# EAGLE board MSP-EXP430FR4133_EagleCAD (EAGLE 7.6.0) (continued)
## Tracks (layer width: path | path; a pad name or v marks a point on that pad's centre or on a via) (continued)
EZFET_UARTRXD  (via drill 0.3)
  Top 0.203: MSP101.38 26.31,93.09 26.31,92.84 26.44,92.71 v26.44,92.2 | J101.7 43.97,76.2 42.7,77.47 41.81,77.47 41.17,78.11 v41.17,80.95
  Bottom 0.203: v26.44,92.2 30.63,88.01 33.81,88.01 35.2,86.61 35.2,82.55 37.11,80.65 40.87,80.65 v41.17,80.95
EZFET_UARTTXD  (via drill 0.3)
  Top 0.203: MSP101.37 26.25,93.79 v26.95,93.09 | J101.9 39.95,78.18 39.95,81.33 v39.65,81.64
  Bottom 0.203: v26.95,93.09 27.08,92.08 30.76,88.39 33.93,88.39 35.59,86.74 35.59,82.68 37.24,81.03 39.04,81.03 v39.65,81.64
EZFET_V18
  Top 0.203: MSP101.55 24.45,86.96 23.22,85.73 22,85.73 18.99,82.72 C102.1
EZFET_VBUS  (via drill 0.3)
  Top 0.203: 9.3,91.19 9.3,91.06 IC102.6 | 9.55,91.19 IC102.6 | IC102.6 | 51.1,95.66 51.1,95.93 C109.+
  Top 0.254: IC103.2 50.32,81.41
  Top 0.305: MSP101.53 23.11,87.02 19.86,87.02 17.55,84.71 13.36,84.71 11.71,83.06 11.33,83.06 | 19.33,89.79 IC101.1 IC101.6
  Top 0.406: 50.32,81.41 C126.1 49.3,81.41
  Top 0.508: 9.3,93.09 9.3,91.19 | 9.55,91.19 v10.69,91.69 | J101.17 30.51,77.47 27.84,77.47 27.2,76.84 10.82,76.84 9.8,77.85 9.8,82.3 10.38,82.87 R124.1 11.33,83.06 5.99,88.37 5.99,91.95 7.14,93.09 9.3,93.09 | v18.31,91.69 18.69,92.08 18.69,92.33 19.08,92.71 19.04,92.71 C108.1 19.37,92.67 19.96,92.08 19.96,90.42 19.33,89.79 | J102.1 9.39,93.19 9.3,93.09 | 51.1,95.66 51.1,94.01 51.06,93.96 R120.1 C118.1 51.06,91.65 C117.1 51.59,91.06 51.59,90.42 51.61,90.42 v51.64,90.45 | T101.2 49.32,88.38 | 49.32,88.38 49.3,88.39 | v49.33,88.34 49.33,88.37 49.32,88.38 | v49.05,82.93 49.3,82.68 49.3,81.45 C126.1
  Top 0.635: C109.+ 50.62,95.88 50.39,95.86 v49.48,95.86
  Bottom 0.305: 48.87,95.81 48.74,95.86
  Bottom 0.508: v10.69,91.69 v18.31,91.69 20.47,93.85 20.47,97.79 22.38,99.7 44.86,99.7 48.74,95.86 v49.48,95.86 | v51.64,90.45 50.62,90.45 49.33,89.15 v49.33,88.34 49.33,87.02 48.03,85.73 48.03,83.95 v49.05,82.93
EZFET_VCC  (via drill 0.3)
  Top 0.152: MSP101.11 32.03,87.38 32.07,87.34 | 33.86,86.79 C114.1 | 33.43,88.77 MSP101.15
  Top 0.203: 24.66,93.32 MSP101.40 | v32,81.59 31.58,81.21 R109.2 | R116.1 27.08,99.44 | C114.1 34.06,87.12 | 33.86,86.79 34.13,87.06 | 34.95,94.74 34.98,94.77
  Top 0.254: 17.93,89.53 IC101.3 | IC103.4 51.59,80.39
  Top 0.305: MSP101.40 25.19,92.82 24.28,93.73 C103.1 23.05,94.32 21.49,95.89 21.49,96.01 C104.+ | 25.52,99.34 R117.1 25.44,99.31 | 46.17,99.73 C124.1 46.04,99.2 45.99,99.1 | 48.14,97.71 C106.+ | 43.59,98.81 45.69,98.81 45.99,99.1 | 38.42,96.82 38.38,97.03 38.38,97.54 39.14,98.3 41.3,98.3 43.46,96.14 46.76,96.14 47.56,96.93 C106.+ | 38.42,96.82 38.43,96.75 | 33.6,88.61 MSP101.15 | 32.07,87.34 32.66,86.74 v32.92,86.74 33.76,86.74 34.13,87.06 35.08,88.01 | v37.11,96.7 37.64,96.7 MSP102.16 MSP102.15 38.42,96.82 | C106.+ 47.73,97.38 47.9,97.59 v47.9,98.81 | 46.06,99.05 45.99,99.1 | 35.08,88.01 35.38,87.83 36.55,87.83 38,89.28 38,90.17 35.46,92.71 35.46,94.23 34.98,94.72 34.98,94.77 v34.98,95.45 | 35.08,88.01 35.14,88.01 C113.1 | 35.08,88.01 34.19,88.01 33.43,88.77
  Top 0.406: 17.85,89.88 17.93,89.75 17.93,89.53 | 17.42,92.46 17.3,92.46 C105.1 17.3,92.62 16.88,92.62
  Top 0.508: 16.88,92.62 16.03,93.47 16.03,95.63 16.28,95.89 18.91,95.89 R114.1 21.26,95.84 C104.+ 23.42,96.04 24.03,96.65 24.03,98.68 24.66,99.31 25.44,99.31 27,99.31 R116.1 27.26,99.37 27.97,100.08 42.32,100.08 43.59,98.81 45.62,98.81 46.02,99.14 46.02,99.64 | 17.85,89.88 17.42,90.3 17.42,92.46 17.34,92.67 17.35,92.67 | v47.9,98.81 47.02,99.7 C124.1 | v55.14,79.6 55.14,79.63 54.89,79.38 52.1,79.38 51.59,79.88 51.59,80.39
  Bottom 0.203: v32.92,86.74 32.92,82.5 v32,81.59
  Bottom 0.305: v37.11,96.7 36.22,96.7 v34.98,95.45
  Bottom 0.508: v47.9,98.81 49.68,98.81 55.14,93.34 v55.14,79.6
EZFET_VCCEN1  (via drill 0.3)
  Top 0.203: MSP101.26 30.69,93.15 31.14,93.6 32.03,93.6 32.66,94.23 33.55,94.23 34.57,93.22 34.57,92.46 36.35,90.68 v36.35,89.53 | v50.06,80.39 50.32,80.39 50.83,80.91 IC103.3 | R107.1 43.15,83.88 v43.21,84.2
  Bottom 0.203: v36.35,89.53 36.47,89.41 39.9,89.41 40.54,88.77 40.54,85.09 41.3,84.33 43.08,84.33 v43.21,84.2 45.11,82.3 47.78,82.3 49.68,80.39 v50.06,80.39
EZFET_VCCEN2  (via drill 0.3)
  Top 0.203: MSP101.27 30.29,93.51 30.76,93.98 31.78,93.98 32.41,94.62 33.81,94.62 34.95,93.47 34.95,92.58 37.11,90.42 v37.11,90.04 | R108.1 v44.35,84.2 | IC103.7 52.47,81.91 52.73,82.17 v52.73,82.68
  Bottom 0.203: v37.11,90.04 39.9,90.04 41.05,88.9 41.05,85.34 41.55,84.84 43.71,84.84 v44.35,84.2 45.87,82.68 48.03,82.68 48.54,82.17 49.3,82.17 50.06,82.93 52.48,82.93 v52.73,82.68
EZFET_VCCOUT
  Top 0.203: R121.1 35.93,81.37 37.24,82.68 40.69,82.68 41.81,83.81 | 41.81,83.81 41.81,83.82 41.94,83.82 42.95,84.84 44.22,84.84 44.73,85.34 44.73,85.38 R127.1 | 41.81,83.81 R112.1
  Top 0.254: 51.59,82.42 IC103.8
  Top 0.305: R126.1 44.74,88.01 R128.1 R127.1 45.4,84.96 45.4,83.45 C120.1 | 46.63,83.48 46.63,83.45
  Top 0.508: 50.55,83.92 50.55,83.46 51.59,82.42
  Top 0.635: 46.63,83.48 47.19,83.92 50.43,83.92 C119.1 50.46,83.9 50.47,83.9 | L101.2 50.44,85.82 50.44,84.18 50.42,84.18 50.42,84.07 50.55,84.07 50.55,83.92 50.47,83.92 50.47,83.9 | 50.47,83.87 50.47,83.9 | 46.63,83.45 C120.1
EZFET_VCCTARGET  (via drill 0.3)
  Top 0.254: IC103.5 52.21,80.91
  Top 0.305: IC103.1 50.71,81.91 v50.32,82.3 | 52.21,80.91 52.6,80.91 52.73,80.77 v52.73,80.21
  Bottom 0.508: J101.15 36.09,77.98 50.5,77.98 v52.73,80.21 52.73,81.15 51.59,82.3 v50.32,82.3
EZFET_VCORE
  Top 0.203: MSP101.17 34.93,91.07 C101.1
EZFET_VREF
  Top 0.203: C121.1 31.98,84.75 31.98,86 MSP101.9
EZFET_VUSB
  Top 0.305: MSP101.54 23.04,86.25 20.36,86.25 20.09,85.98 | C107.1 20.09,85.98 | 20.09,85.98
EZFET_XT2IN
  Top 0.203: MSP101.57 25.16,86.27 24.23,85.32 23.24,85.32 22.06,84.14 22,84.07
  Top 0.406: Q101.1 22.06,84.08 22.06,84.14
EZFET_XT2OUT
  Top 0.203: MSP101.58 24.79,85.17 24.79,82.8 24.2,82.21
  Top 0.406: Q101.3 24.2,81.96 24.2,82.21
GND  (via drill 0.3)
  Top 0.152: v25.17,95.25 25.17,93.47 25.43,93.22 MSP101.39 | MSP102.TP 38.76,96.39 39.14,96.77 MSP102.14 | 26.79,88.05 26.82,88.01 MSP101.TP 27.2,88.65
  Top 0.203: 33.63,89.31 33.53,89.31 | 33.63,89.31 33.63,89.3 MSP101.16 | MSP101.56 24.83,86.66 | MSP101.39 25.93,92.76 25.93,92.61 25.76,92.43 | MSP101.14 32.79,88.72 32.79,89.05 33.1,89.38 33.53,89.38 33.63,89.31
  Top 0.254: 24.83,86.66 24.86,86.66 25.12,86.92 v25.12,88.16 | Q101.2 22.95,82.9 21.62,81.56
  Top 0.305: 21.62,81.56 18.46,81.53 C102.2 | MSP1.8 22.45,54.73 22.2,54.74 v21.79,54.33
  Bottom 0.203: v20.68,82.32 21.23,82.32 21.72,82.8
  other vias: 10.57,85.73 8.89,86.74 51.08,100.2 41.45,96.77 24.18,84.68 33.91,92.79 35.33,89.28 19.96,100.46 23.01,93.34 53.49,81.36 43.69,97.94 46.18,84.68 45.75,86.51 47.83,94.23 44.09,91.19 52.7,98.93 17.25,98.04 47.07,100.46 35.56,90.55 48.34,89.03 49.1,92.86 8.43,82.63 16.59,83.97 25.17,96.88 28.85,97.89 17.07,82.75 22.35,80.87 19.02,83.87 27.08,74.17 27.41,85.37 30.66,91.57 12.22,80.14 22.12,97.56 5.18,90.55 5.23,94.23 16.66,100.33 5.79,97.51 15.72,92.48 13.36,87.25 11.66,92.53 14.88,95.25 16.1,88.39 8.41,89.28 11.46,94.49 27.71,82.3 47.8,90.14 38.4,88.52 41.61,92.15 42.62,85.6 49.76,97.1 21.62,91.44 41.81,89 7.9,80.01 48.29,71.25 48.41,59.82 45.62,71.37 43.08,71.37 38.1,72.14 1.17,81.28 1.17,90.17 1.17,95.63 21.74,100.46 46.13,3.94 57.18,6.48 57.18,10.16 57.18,53.34 57.18,59.69 57.18,66.04 57.18,72.39 57.2,78.66 57.48,86.97 57.53,91.57 57.53,95.58 54.69,94.95 56.44,85.09 54.64,77.98 54.64,72.52 11.35,64.8 19.33,71.88 46.25,62.61 13.23,34.04 15.39,33.91 17.81,33.91 20.35,33.91 22.89,33.91 25.43,33.91 27.97,33.91 30.63,33.78 33.05,33.78 35.59,33.78 38.13,33.78 40.67,33.78 43.21,33.78 43.84,11.81 45.11,11.68 48.29,33.78 44.98,41.4 22.63,64.92 7.65,33.78 10.31,33.91 10.19,20.32 10.19,26.8 15.27,26.92 15.27,20.19 17.93,20.19 17.93,26.92 20.47,26.8 20.47,20.07 23.14,27.05 23.01,20.19 25.43,27.31 25.55,20.19 28.09,27.31 28.09,20.32 30.76,27.18 30.89,20.32 33.17,27.18 33.17,20.32 35.84,27.18 35.59,20.32 38.25,27.18 38.25,20.32 40.92,27.18 40.92,20.32 43.46,27.18 43.59,20.32 48.29,27.05 48.29,20.45 8.41,13.84 5.87,15.88 4.34,16.64 52.6,17.78 50.06,16.13 47.52,14.48 48.41,49.02 50.6,47.68 49.05,44.2 49.68,42.55 15.39,69.09 19.58,66.04 7.01,1.65 11.79,0.81 21.74,1.02 1.04,5.59 1.04,13.08 1.04,22.86 1.04,31.75 1.04,41.91 1.17,52.07 1.3,61.72 1.04,72.01 40.03,2.29 43.33,2.29 32.08,7.09 24.03,7.62 13.82,8.08 6.73,7.92 42.14,8.23 57.18,18.29 57.3,27.94 57.3,37.72 57.3,45.97 16.79,58.93 16.79,60.07 49.07,37.26 50.83,52.07 50.24,55.8 44.73,66.17 38.51,69.6 35.97,68.96 5.36,73.53 32.79,68.96 1.55,66.17 11.4,59.08 25.43,77.72 27.08,75.69 15.77,77.72 15.77,75.95 7.9,75.69 45.75,68.96 25.91,80.49 48.03,68.33 5.74,69.09 13.59,66.6 50.7,50.42 31.52,2.06 16.89,63.17 12.47,57 16.87,51.66 16.87,53.04 12.19,54.71 16.92,56.36 6.05,85.09 19.15,91.19 17.3,85.85 26.59,90.04 28.19,88.37 38.15,95.5 39.42,94.62 21.49,89.53 7.21,91.9 12.85,94.49 13.36,90.55 28.91,91.8 53.64,90.58 37.72,87.81 34.04,84.51 52.86,78.41 49.02,84.96 54.05,84.46 50.06,78.82 53.44,83.49 45.67,80.87 26.64,67.39 24.23,60.02 51.26,89.03 28.88,93.34 36.12,98.68 42.24,82.65
  pour Top: 0.03,101.6 0.03,0 58.45,0 58.45,101.6
  pour Bottom: 0.03,101.6 0.03,0 58.45,0 58.45,101.6
L0
  Top 0.203: LCD1.35 43.21,38.23 42.82,38.61 42.82,50.55 44.73,52.45 44.73,55.88 43.33,57.28 43.33,62.61 40.79,65.15 27.2,65.15 25.54,63.48 MSP1.64
L1  (via drill 0.3)
  Top 0.203: LCD1.36 45.75,37.34 43.71,39.37 43.71,49.4 45.11,50.8 45.11,56.13 43.71,57.53 43.71,62.99 41.15,65.56 28.4,65.56 v27.76,66.22 | MSP1.63 26.04,62.71 27.71,64.39
  Top 0.406: v27.71,64.36 27.71,64.39
  Bottom 0.203: v27.71,64.36 27.71,66.17 v27.76,66.22
L2  (via drill 0.3)
  Top 0.203: v28.78,66.17 41.17,66.17 44.22,63.12 44.22,57.79 45.49,56.52 45.49,50.55 44.22,49.28 44.22,39.62 LCD1.37 | MSP1.62 26.54,62.2 v28.73,64.39
  Bottom 0.203: v28.73,64.39 28.73,66.12 v28.78,66.17
L3  (via drill 0.3)
  Top 0.203: LCD1.38 50.83,36.58 44.73,42.8 44.73,49.15 45.87,50.29 45.87,56.77 44.73,57.91 44.73,63.25 41.17,66.8 v29.74,66.8 | MSP1.61 27.04,61.68 v29.74,64.39
  Bottom 0.203: v29.74,64.39 v29.74,66.8
L4  (via drill 0.3)
  Top 0.203: v42.57,60.07 42.57,62.74 40.54,64.77 31.14,64.77 27.54,61.17 MSP1.60 | LCD1.4 45.75,13.72 52.1,20.07 52.1,36.32 45.62,42.93 45.62,49.28 46.25,49.91 46.25,57.02 45.49,57.79 v45.49,60.07
  Bottom 0.203: v42.57,60.07 v45.49,60.07
L5  (via drill 0.3)
  Top 0.203: v41.81,59.44 41.81,62.87 40.28,64.39 31.39,64.39 28.04,61.03 MSP1.59 | LCD1.3 48.29,15.49 52.6,19.81 52.6,36.58 46,43.18 46,49.02 46.63,49.66 46.63,57.15 46.13,57.66 46.13,59.31 v46.18,59.36
  Bottom 0.203: v41.81,59.44 46.1,59.44 v46.18,59.36
L6  (via drill 0.3)
  Top 0.203: LCD1.2 50.83,17.02 53.24,19.43 53.24,36.58 46.38,43.43 46.38,48.9 47.04,49.56 47.04,58.57 v46.91,58.7 | v42.6,58.7 41.35,58.7 40.92,59.13 40.92,63.12 40.03,64.01 31.65,64.01 28.54,60.9 MSP1.58
  Bottom 0.203: v42.6,58.7 v46.91,58.7
L7  (via drill 0.3)
  Top 0.203: v48.41,57.68 48.41,50.29 46.76,48.64 46.76,43.82 53.75,36.83 53.75,19.05 53.37,18.67 LCD1.1 | v42.57,57.68 41.78,57.68 40.41,59.06 40.41,62.99 39.78,63.63 31.78,63.63 29.04,60.89 MSP1.57
  Bottom 0.203: v42.57,57.68 v48.41,57.68
L8
  Top 0.203: LCD1.20 5.11,16.89 4.22,17.78 4.22,36.58 12.98,45.34 15.52,45.34 16.54,46.36 20.47,46.36 24.66,50.55 24.66,52.83 25.43,53.59 25.43,55.37 29.54,59.48 MSP1.56
L9
  Top 0.203: LCD1.19 7.65,15.11 4.72,18.03 4.72,36.45 13.23,44.96 15.77,44.96 16.79,45.97 20.6,45.97 25.04,50.42 25.04,52.58 25.81,53.34 25.81,55.12 30.04,59.35 MSP1.55
L10
  Top 0.203: LCD1.18 10.19,13.34 5.36,18.16 5.36,36.32 13.61,44.58 16.03,44.58 16.92,45.47 20.65,45.47 21.23,46.05 24.79,49.66 25.55,50.42 25.55,52.32 26.19,52.96 26.19,54.99 30.54,59.34 MSP1.54
L11  (via drill 0.3)
  Top 0.203: LCD1.17 12.73,15.11 9.04,18.67 9.04,37.34 14.38,42.67 21.23,42.67 23.65,45.09 v25.3,45.09 | MSP1.53 31.04,59.21 26.57,54.74 26.57,52.71 26.44,52.58 v26.44,51.94
  Bottom 0.203: v25.3,45.09 25.3,50.8 v26.44,51.94
L12  (via drill 0.3)
  Top 0.203: LCD1.16 15.27,13.72 11.46,17.53 11.46,38.48 14.76,41.78 21.49,41.78 23.65,43.94 25.93,43.94 v26.57,44.58 | MSP1.52 31.54,59.2 27.2,54.86 v27.2,52.96
  Bottom 0.203: v27.2,52.96 27.2,51.56 25.81,50.17 25.81,45.59 26.57,44.83 v26.57,44.58
L13  (via drill 0.3)
  Top 0.203: MSP1.51 32.03,59.18 27.84,54.99 v27.84,52.07 | v27.91,44.12 26.95,43.18 24.03,43.18 21.87,41.02 15.65,41.02 14,39.37 14,16.51 17.81,12.7 LCD1.15
  Bottom 0.203: v27.84,52.07 27.84,51.56 26.31,50.04 26.31,45.72 v27.91,44.12
L14  (via drill 0.3)
  Top 0.203: MSP1.50 32.54,59.06 28.6,55.12 v28.6,52.83 | v28.73,43.18 27.97,42.42 24.28,42.42 22.12,40.26 16.28,40.26 15.65,39.62 15.65,37.08 16.54,36.2 16.54,16.51 20.35,12.7 LCD1.14
  Bottom 0.203: v28.6,52.83 28.6,51.44 26.82,49.66 26.82,46.23 28.73,44.32 v28.73,43.18
L15  (via drill 0.3)
  Top 0.203: 33.05,60.19 33.05,58.93 29.49,55.37 v29.49,51.94 | LCD1.13 22.89,12.7 19.08,16.51 19.08,36.07 21.23,38.23 23.14,38.23 25.32,40.41 29.64,40.41 30.51,41.28 v30.51,41.3 | 33.05,60.2 33.05,60.19 | 33.05,60.19 MSP1.49
  Bottom 0.203: v30.51,41.3 30.35,41.43 29.36,42.42 29.36,44.32 27.33,46.36 27.33,49.53 29.24,51.44 v29.49,51.94
L16  (via drill 0.3)
  Top 0.203: LCD1.12 24.28,11.3 24.16,36.96 26.19,38.99 34.44,38.99 39.01,43.56 v39.01,51.69 | v43.08,51.69 44.35,52.96 44.35,55.5 42.82,57.02 41.81,57.02 40.6,58.23 MSP1.48
  Bottom 0.203: v43.08,51.69 v39.01,51.69
L17  (via drill 0.3)
  Top 0.203: LCD1.11 26.7,11.43 26.7,36.96 28.35,38.61 34.82,38.61 39.65,43.43 39.65,52.07 39.01,52.71 v39.01,53.59 | MSP1.47 40.46,57.73 41.55,56.64 42.57,56.64 43.71,55.5 v43.71,53.72
  Bottom 0.203: v39.01,53.59 43.59,53.59 v43.71,53.72
L18  (via drill 0.3)
  Top 0.203: v43.08,52.96 43.08,55.5 42.44,56.13 41.3,56.13 40.2,57.23 MSP1.46 | LCD1.10 29.24,11.43 29.24,36.96 30.38,38.1 34.82,38.1 40.03,43.31 40.03,52.71 v39.78,52.96
  Bottom 0.203: v43.08,52.96 v39.78,52.96
L19
  Top 0.203: MSP1.45 40.07,56.73 41.43,55.37 41.43,42.16 36.86,37.59 36.86,9.27 36.35,8.76 33.55,8.76 33.05,9.27 LCD1.9
L20
  Top 0.203: MSP1.44 39.55,56.23 41.05,54.74 41.05,42.55 34.32,35.94 34.32,11.43 LCD1.8
L21
  Top 0.203: MSP1.43 39.54,55.73 40.54,54.74 40.54,43.05 34.95,37.47 33.17,37.47 31.78,36.07 31.78,9.65 33.3,8.13 36.6,8.13 38.13,9.65 LCD1.7
L22  (via drill 0.3)
  Top 0.203: LCD1.6 40.67,13.08 39.4,14.35 39.4,37.21 41.81,39.62 41.81,54.86 v42.27,55.35 | MSP1.42 34.99,55.24 38.76,55.24 v39.01,54.99
  Top 0.406: v39.01,54.99
  Bottom 0.203: v39.01,54.99 41.93,54.99 42.27,55.32 | 42.27,55.32 42.32,55.37 | v42.27,55.35 42.27,55.32
L23  (via drill 0.3)
  Top 0.203: LCD1.5 43.21,15.49 41.94,16.76 41.94,38.86 42.44,39.37 v42.44,54.36 | MSP1.41 38.38,54.73 38.76,54.36 v39.78,54.36
  Bottom 0.203: v42.44,54.36 v39.78,54.36
L24
  Top 0.203: LCD1.27 22.89,36.45 25.93,39.5 34.32,39.5 38.38,43.56 38.38,53.59 37.74,54.23 MSP1.40
L25
  Top 0.203: LCD1.26 21.11,35.56 25.55,40.01 34.19,40.01 38,43.82 38,53.21 37.48,53.73 MSP1.39
L26
  Top 0.203: LCD1.25 20.85,38.61 22.89,38.61 25.17,40.89 29.24,40.89 30.89,42.55 36.09,42.55 37.62,44.07 37.62,52.83 37.22,53.23 MSP1.38
L36
  Top 0.203: LCD1.24 15.27,40.13 15.77,40.64 22,40.64 24.16,42.8 27.46,42.8 29.24,44.58 30,44.58 31.04,45.62 MSP1.28
L37
  Top 0.203: LCD1.23 12.73,38.74 15.39,41.4 21.62,41.4 23.77,43.56 26.44,43.56 27.84,44.96 29.74,44.96 30.54,45.75 MSP1.27
L38
  Top 0.203: LCD1.22 10.19,37.85 14.5,42.16 21.36,42.16 23.65,44.45 25.55,44.45 26.44,45.34 29.36,45.34 30.04,46.01 MSP1.26
L39
  Top 0.203: LCD1.21 7.65,36.45 14.25,43.05 20.98,43.05 23.65,45.72 28.98,45.72 29.54,46.28 MSP1.25
N$1
  Top 0.203: 32.66,97.03 32.82,97.18 | 32.82,97.18 32.92,97.28 | R101.1 32.66,97.28 | 32.66,97.28 | 32.82,97.18 LED101.A 32.66,97.27 32.66,97.28
N$2
  Top 0.203: R102.1 32.14,98.41 32.73,99 | 32.73,99 32.79,99.06 | LED102.A 32.73,99
N$4
  Top 0.254: C1.1 18.82,61.09 | MSP1.1 22.18,58.23 19.33,61.09 18.95,61.09
  Top 0.406: C1.1 18.95,61.09
N$6
  Top 0.203: R4.1 27.46,5.59 JP1.2
N$7
  Top 0.203: R4.2 24.37,5.55 23.9,5.08 23.9,4.18 LED1.A
N$8
  Top 0.203: LED2.A 34.73,5.01 R5.2
N$10
  Top 0.254: MSP1.2 22.05,57.73 19.71,60.07 18.91,60.07 C2.1
N$11
  Top 0.254: MSP1.4 21.14,56.73 19.96,57.91 18.94,57.91 C4.1
N$12
  Top 0.305: R119.1 45.53,89.75 45.87,89.41 46.76,89.41 46.78,89.39 T102.2
N$13
  Top 0.254: T102.1 D101.2 D101.1 46.27,94.88 45.87,94.49 44.98,94.49 R118.1
  Top 0.305: R118.1 44.79,94.5
N$14
  Top 0.203: 19.86,55.25 Y1.P2 | Y1.P2 19.47,55.36 18.9,55.93 18.9,56.43 C5.1 | MSP1.6 20.83,55.73 20.35,55.25 19.99,55.25 Y1.P2
N$15
  Top 0.635: L101.1 53.23,86.64 53.23,86.74 | 53.23,86.74 53.24,87.76 53.24,88.27 52.48,89.03 T101.3 | D102.3 48.68,87 49.17,87.5 52.35,87.5 53.11,86.74 53.23,86.74
N$16
  Top 0.203: T102.3 48.8,90.03 48.29,90.55 48.29,93.73 48.79,94.23 49.68,94.23 49.96,93.96 R120.2 | T101.1 50.38,89.73 50.06,90.04 T102.3 | 48.79,90.04 T102.3
  Top 0.406: 48.79,94.23 D101.3
N$17
  Top 0.254: MSP1.5 20.88,56.23 19.96,57.15 18.6,57.15 C4.2
N$18
  Top 0.203: 19.84,54.23 19.91,54.31 19.96,54.31 19.95,54.29 Y1.P1 | Y1.P1 19.52,54.29 18.87,53.65 C6.1 | Y1.P1 20.41,54.29 21.36,55.25 23.57,55.25 MSP1.7
N$19
  Top 0.203: 18.79,58.98 C3.1
  Top 0.254: MSP1.3 21.74,57.23 19.99,58.98 18.91,58.98 C3.1
P1.0/TXD  (via drill 0.3)
  Top 0.203: v11.84,13.34 6.38,18.8 6.38,35.81 14.25,43.69 v16.92,43.69 20.98,43.69 23.67,46.38 v28.7,46.38 29.03,46.71 29.03,47.09 29.04,47.32 MSP1.24 | v13.87,13.34 13.87,9.27 14.63,8.51 28.09,8.51 29.24,7.37 JP1.1 | v39.27,62.61 38.89,62.23 37.62,62.23 31.14,55.75 v31.14,52.07 | v41.17,71.12 41.17,71.25 42.06,72.14 42.95,72.14 J101.8 | v14.12,49.91 13.49,50.55 10.44,50.55 7.77,53.21 7.77,54.48 J1.4
  Bottom 0.203: v11.84,13.34 v13.87,13.34 | v39.27,62.61 41.17,64.52 v41.17,71.12 | v31.14,52.07 31.14,51.69 28.73,49.28 28.73,46.36 v28.7,46.38 | v14.12,49.91 14.12,48.77 16.15,46.74 16.15,44.45 v16.92,43.69
P1.1/RXD  (via drill 0.3)
  Top 0.203: v17.68,44.32 20.85,44.32 23.55,47.02 v28.04,47.02 28.54,47.51 MSP1.23 | v38.38,62.99 37.74,62.99 30.33,55.58 v30.33,52.81 | v40.54,70.36 40.54,71.37 41.94,72.77 J101.10 | v15.14,49.91 14.12,50.93 10.82,50.93 8.41,53.34 8.41,56.39 J1.3
  Bottom 0.203: v38.38,62.99 38.76,62.99 40.54,64.77 v40.54,70.36 | v30.33,52.81 30.33,51.77 27.97,49.4 27.97,47.07 v28.04,47.02 | v17.68,44.32 17.17,44.32 16.66,44.83 16.66,46.99 15.14,48.51 v15.14,49.91
P1.2
  Top 0.203: 28.04,48.2 MSP1.22 28.09,48.73 28.09,48.39 28.04,48.34 28.04,47.98 27.69,47.62 23.52,47.62 20.85,44.96 17.17,44.96 16.41,44.2 14,44.2 5.87,36.07 5.87,18.29 11.46,12.7 11.46,7.02 11.47,7.02 S1.4 11.46,6.87 11.46,6.98 20.07,6.98 S1.3
P1.3  (via drill 0.3)
  Top 0.203: MSP1.21 27.54,49.61 27.71,49.78 33.43,49.78 33.81,49.4 33.81,47.75 34.57,46.99 v35.2,46.99
  Bottom 0.203: v35.2,46.99 46.89,46.99 47.14,46.74 48.54,46.74 48.79,46.99 50.83,46.99 J2.13
P1.4  (via drill 0.3)
  Top 0.203: v48.16,47.37 48.16,43.94 48.79,43.31 51.97,43.31 J2.12 | MSP1.20 27.04,49.62 27.58,50.17 33.55,50.17 34.19,49.53 34.19,48.13 34.7,47.62 v35.97,47.62
  Bottom 0.203: v35.97,47.62 47.02,47.62 47.27,47.37 v48.16,47.37
P1.5  (via drill 0.3)
  Top 0.203: v47.52,48.26 47.52,43.69 50.57,40.64 J2.11 | MSP1.19 26.54,49.75 27.33,50.55 33.81,50.55 34.57,49.78 34.57,48.51 34.82,48.26 v35.2,48.26
  Bottom 0.203: v35.2,48.26 v47.52,48.26
P1.6  (via drill 0.3)
  Top 0.203: v47.78,60.96 49.56,60.96 J2.18 | v39.65,60.2 37.49,60.2 v36.73,59.44 | MSP1.18 26.04,49.89 27.08,50.93 32.41,50.93 33.05,51.56 33.05,55.63 v33.3,55.88
  Bottom 0.203: v39.65,60.2 40.41,60.96 v47.78,60.96 | v33.3,55.88 v36.73,59.44
P1.7  (via drill 0.3)
  Top 0.203: v46.51,61.6 51.46,61.6 J2.19 | MSP1.17 25.54,49.9 26.95,51.31 32.16,51.31 32.41,51.56 32.41,56.01 v33.3,56.9 | v39.52,61.21 37.62,61.21 v35.71,59.31
  Bottom 0.203: v33.3,56.9 v35.71,59.31 | v46.51,61.6 40.41,61.6 39.9,61.6 v39.52,61.21
P2.3/RTS  (via drill 0.3)
  Top 0.203: v43.46,66.17 45.49,64.14 45.49,61.72 49.05,58.17 v49.05,52.88 | v43.46,68.71 37.49,68.71 36.86,69.34 J101.14 | 35.08,52.71 35.05,52.73 MSP1.37 35.01,52.71 36.09,52.71 36.2,52.6 v36.55,52.6
  Bottom 0.203: v43.46,66.17 v43.46,68.71 | v49.05,52.88 49.05,52.83 48.54,52.32 38,52.32 37.69,52.63 v36.55,52.6
P2.4/CTS  (via drill 0.3)
  Top 0.203: v47.65,51.46 47.65,58.93 45.11,61.47 45.11,63.63 42.7,66.04 v42.7,66.68 | v42.7,69.34 39.9,69.34 39.4,69.85 J101.12 | MSP1.36 35.04,52.23 35.08,52.2 35.97,52.2 36.4,51.77 v36.98,51.77
  Bottom 0.203: v42.7,66.68 v42.7,69.34 | v47.65,51.46 47.24,51.05 37.69,51.05 v36.98,51.77
P2.5  (via drill 0.3)
  Top 0.203: MSP1.35 35.8,51.73 36.35,51.18 36.73,51.18 37.11,50.8 37.11,44.2 35.84,42.93 30.63,42.93 28.98,41.28 24.92,41.28 22.63,38.99 18.44,38.99 17.68,38.23 v16.54,38.23 | v14.12,45.97 6.63,45.97 J1.8
  Bottom 0.203: v16.54,38.23 14.63,40.13 14.63,45.47 v14.12,45.97
P2.6  (via drill 0.3)
  Top 0.203: v43.71,50.42 43.33,50.04 43.33,38.99 44.48,37.85 44.48,7.62 44.85,7.24 | MSP1.34 35.66,51.23 36.47,50.42 v36.5,50.42 | 44.85,7.24 S2.3 | S2.4 44.49,6.87 44.85,7.24
  Bottom 0.203: v43.71,50.42 v36.5,50.42
P2.7  (via drill 0.3)
  Top 0.203: v13.11,49.91 10.31,49.91 6.88,53.34 J1.5 | MSP1.33 35.53,50.73 35.84,50.42 35.84,50.04 36.6,49.28 36.6,44.32 35.59,43.31 30.38,43.31 28.73,41.66 24.66,41.66 22.5,39.5 17.81,39.5 v17.55,39.24
  Bottom 0.203: v17.55,39.24 15.77,41.02 15.77,46.36 13.11,49.02 v13.11,49.91
P4.0
  Top 0.203: R5.1 32.93,5.72 31.9,5.72 31.27,5.08 31.27,3.3 30.38,2.41 23.77,2.41 20.73,5.46 9.68,5.46 8.15,6.98 4.85,6.98 3.58,8.26 3.58,50.42 5.11,51.94 7.52,51.94 10.19,49.28 20.09,49.28 20.98,50.17 20.98,51.31 22.41,52.73 MSP1.12
P5.0  (via drill 0.3)
  Top 0.203: v49.05,46.36 49.05,48.51 50.06,49.53 50.06,54.61 51.33,55.88 J2.17 | MSP1.32 33.04,47.38 34.06,46.36 35.08,46.36 35.08,46.35 v35.96,46.35 v35.97,46.36
  Bottom 0.203: v35.97,46.36 v49.05,46.36
P5.1  (via drill 0.3)
  Top 0.203: v16.54,39.24 17.04,39.88 22.25,39.88 24.54,42.04 28.47,42.04 30.38,43.94 v33.93,43.94 | MSP1.31 32.54,46.61 33.43,45.72 v33.93,45.72 | v15.14,45.97 14.5,46.61 8.03,46.61 J1.7
  Bottom 0.203: v33.93,45.72 v33.93,43.94 | v15.14,45.97 15.14,40.64 v16.54,39.24
P5.2  (via drill 0.3)
  Top 0.203: v49.81,45.72 49.81,48.51 J2.15 | v34.95,45.72 34.19,44.96 33.43,44.96 32.04,46.35 MSP1.30
  Bottom 0.203: v34.95,45.72 v49.81,45.72
P5.3  (via drill 0.3)
  Top 0.203: v48.79,45.09 50.06,45.09 50.44,45.47 50.44,46.61 J2.14 | v35.84,45.09 35.2,45.09 34.7,44.58 33.17,44.58 31.54,46.21 MSP1.29
  Bottom 0.203: v35.84,45.09 v48.79,45.09
P8.0
  Top 0.203: MSP1.16 23.07,50.73 22.76,50.42 22.76,49.4 20.35,46.99 10.19,46.99 J1.6
P8.1  (via drill 0.3)
  Top 0.203: v11.07,51.56 8.92,53.72 8.92,58.42 J1.2 | v13.23,47.62 20.35,47.62 22.25,49.53 22.25,50.67 22.81,51.23 MSP1.15
  Bottom 0.203: v13.23,47.62 13.23,48.26 12.34,49.15 12.34,51.05 11.84,51.56 v11.07,51.56
P8.2  (via drill 0.3)
  Top 0.203: v11.96,45.21 9.93,45.21 7.9,43.18 J1.9 | v11.96,47.62 12.6,48.26 20.35,48.26 21.87,49.78 21.87,50.93 22.68,51.73 MSP1.14
  Bottom 0.203: v11.96,47.62 v11.96,45.21
P8.3  (via drill 0.3)
  Top 0.203: v10.95,47.62 12.09,48.77 20.22,48.77 21.49,50.04 21.49,51.18 22.54,52.23 MSP1.13 | v10.95,44.58 10.31,44.58 J1.10
  Bottom 0.203: v10.95,47.62 v10.95,44.58
RST/SBWTDIO  (via drill 0.3)
  Top 0.203: 47.02,74.04 J101.6 47.02,68.83 v46.25,68.07 22.76,68.07 19.14,64.45 v18.89,64.45 C11.1 R1.2 18.94,62.1 21.11,62.1 24.66,58.55 24.66,54.1 24.29,53.73 MSP1.10 | v46.25,66.68 52.22,66.68 54.64,64.26 54.64,55.88 J2.16 | S3.3 S3.4 16.14,67.68 v16.54,68.07
  Bottom 0.203: v46.25,66.68 v46.25,68.07 | v18.89,64.45 16.54,66.8 v16.54,68.07
TEST/SBWTCK
  Top 0.203: J101.4 49.43,73.53 49.43,68.33 48.54,67.44 27.84,67.44 25.04,64.64 25.04,53.85 24.43,53.23 MSP1.11

## Text on the board
tPlace: RST | P5.7 | P5.6 | P5.5 | P5.4 | P2.2 | P2.1 | P2.0 | NC | NC | NC | NC | NC | NC | NC | P7.0 | P7.1 | P7.2 | P7.3 | P3.0 | P3.1 | P3.2 | P3.3 | P3.4 | P3.5 | P3.6 | P3.7 | P6.0 | P6.1 | P6.2 | P6.3 | P6.4 | P6.5 | P6.6 | P6.7 | P7.4 | P7.5 | P7.6 | P7.7 | P1.0 | P4.0 | P1.2 | P2.6
tDocu: IC103 | eZ-FET Rev1.2 | Rev 1.1 | MSP-EXP430FR4133 | GND | 5V | 3V3 | RTS >> | CTS << | RXD << | TXD >> | SBWTDIO | SBWTCK | P8.1 | PWM | P1.7 | P1.1 | I/O! | RXD | P1.6 | P1.0 | I/O | TXD | P5.0 | P2.7 | I/O! | !RST | P8.0 | MOSI | A8 | P5.2 | P5.1 | MISO | SCLK | P5.3 | P2.5 | I/O! | I/O! | P1.3 | P8.2 | I/O! | SCL | * | P1.4 | P8.3 | * | I/O! | SDA | P1.5
bDocu: J1 | J3 | J2 | P8.1 | PWM | P1.7 | P1.1 | I/O! | RXD | P1.6 | P1.0 | I/O | TXD | P5.0 | P2.7 | I/O! | !RST | P8.0 | MOSI | A8 | P5.2 | P5.1 | MISO | SCLK | P5.3 | P2.5 | I/O! | I/O! | P1.3 | P8.2 | I/O! | * | SCL | P1.4 | P8.3 | * | I/O! | SDA | P1.5